# EasyEDA Pro project kuafu01_030内部老化方案_4.eprj, board PCB4 (continued)
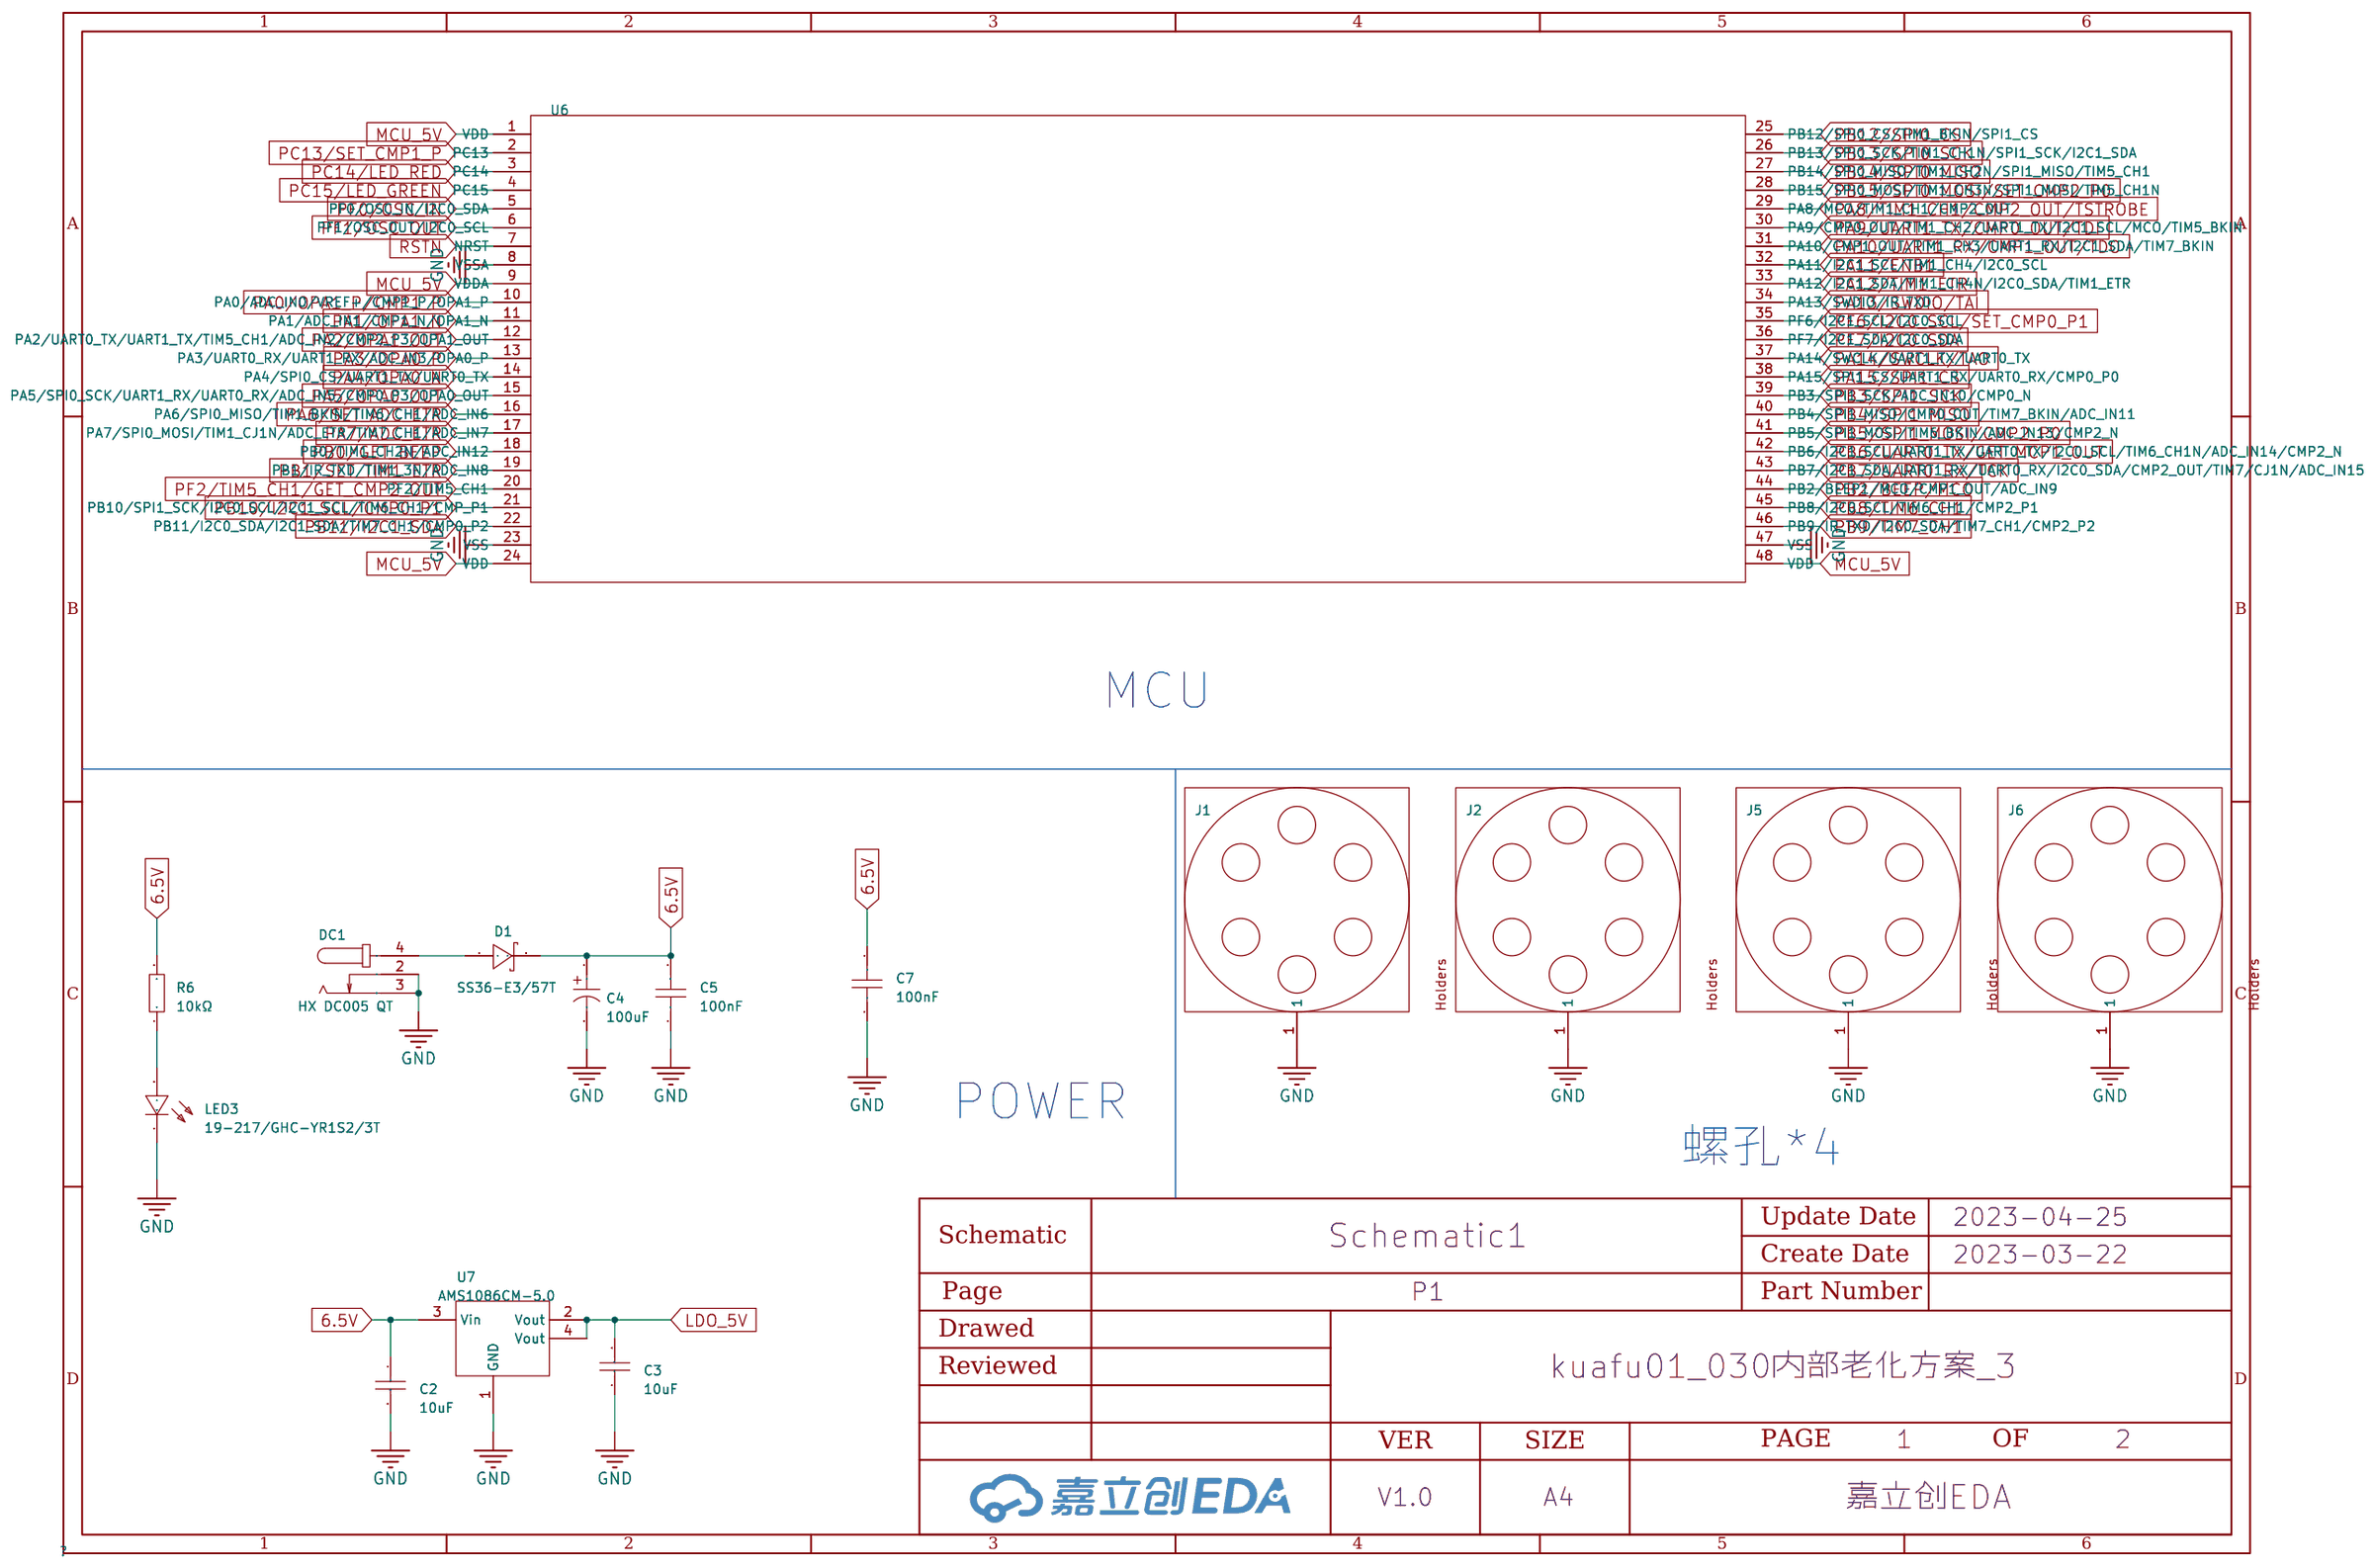
[diagram p0: P1]
## Routing (per net, layer and track width the routed paths; a pad name or vN(x,y) marks a point on that pad's centre or on a via; arc(x,y) is an arc through that point) (continued)
  Top Layer w0.5: v2(131.66,105.31) 131.66,106.78 CN2#19.3 138.35,102.93 138.35,100.24 137.42,99.31 CN1#18.9 ; v2(72.36,79.23) 73.72,79.23 U2#15.2 ; v2(173.45,116.82) 174.81,116.82 U2#9.2 ; v2(210.06,78.04) 210.06,80.2 C1#17.2 209.67,80.73 U1#19.3 209.67,84.87 C6#15.1 210.11,85.97 v2(209.45,86.63) ; v2(232.75,142.9) 232.75,144.38 CN2#2.3 239.44,140.53 239.44,137.83 238.52,136.91 CN1.9 ; v2(7.87,2.85) 7.87,5.01 C1#24.2 7.48,5.54 U1#24.3 7.48,9.68 C6#24.1 7.92,10.78 v2(7.26,11.44) ; v2(19.5,160.56) 19.47,160.53 19.47,159.34 20.12,158.69 v2(21.81,158.69) ; v2(57.81,124.22) 58.47,123.56 C6#7.1 58.03,122.46 U1#9.3 58.03,118.32 C1#7.2 58.42,117.79 v2(58.42,115.63) ; v2(224,8.32) 222.31,8.32 221.66,8.97 221.66,10.16 v2(221.69,10.19) ; v2(72.36,116.82) 73.72,116.82 U2#3.2 ; CN1#7.9 137.42,174.5 138.35,175.42 138.35,178.12 CN2#8.3 131.66,181.97 v2(131.66,180.49) ; v2(182.2,67.71) 182.2,69.19 CN2#21.3 188.89,65.34 188.89,62.64 187.97,61.72 CN1#21.9 ; v2(131.66,218.08) 131.66,219.56 CN2#31.3 138.35,215.71 138.35,213.01 137.42,212.09 CN1#31.9 ; v2(7.87,153.22) 7.87,155.38 C1#4.2 7.48,155.91 U1#6.3 7.48,160.05 C6#5.1 7.92,161.15 v2(7.26,161.81) ; v2(58.42,78.04) 58.42,80.2 C1#19.2 58.03,80.73 U1#21.3 58.03,84.87 C6#19.1 58.47,85.97 v2(57.81,86.63) ; v2(72.36,154.41) 73.72,154.41 U2#4.2 ; v2(232.75,255.67) 232.75,257.15 CN2#26.3 239.44,253.3 239.44,250.6 238.52,249.68 CN1#26.9 ; U2#23.2 23.17,229.59 v2(21.81,229.59) ; v2(7.87,78.04) 7.87,80.2 C1#15.2 7.48,80.73 U1#17.3 7.48,84.87 C6#16.1 7.92,85.97 v2(7.26,86.63) ; v2(158.9,86.63) 159.56,85.97 C6#21.1 159.12,84.87 U1#23.3 159.12,80.73 C1#21.2 159.51,80.2 v2(159.51,78.04) ; v2(72.36,121.1) 70.67,121.1 70.02,121.75 70.02,122.94 v2(70.05,122.97) ; v2(158.9,161.81) 159.56,161.15 C6#10.1 159.12,160.05 U1#11.3 159.12,155.91 C1#10.2 159.51,155.38 v2(159.51,153.22) ; v2(224,41.63) 225.36,41.63 U2#18.2 ; CN1#23.9 238.52,24.13 239.44,25.05 239.44,27.75 CN2#24.3 232.75,31.6 v2(232.75,30.12) ; U2#25.2 225.36,4.04 v2(224,4.04) ; v2(70.05,198.15) 70.02,198.12 70.02,196.93 70.67,196.28 v2(72.36,196.28) ; v2(158.9,199.4) 159.56,198.74 C6#32.1 159.12,197.64 U1#30.3 159.12,193.5 C1#29.2 159.51,192.97 v2(159.51,190.81) ; v2(21.81,41.63) 23.17,41.63 U2#13.2 ; v2(173.45,41.63) 174.81,41.63 U2#19.2 ; v2(21.81,192) 23.17,192 U2#30.2 ; CN1#24.9 36.33,249.68 37.25,250.6 37.25,253.3 CN2#25.3 30.56,257.15 v2(30.56,255.67) ; v2(30.56,67.71) 30.56,69.19 CN2#12.3 37.25,65.34 37.25,62.64 36.33,61.72 CN1#15.9 ; CN1#27.9 36.33,212.09 37.25,213.01 37.25,215.71 CN2#28.3 30.56,219.56 v2(30.56,218.08) ; CN1#13.9 187.97,99.31 188.89,100.24 188.89,102.93 CN2#15.3 182.2,106.78 v2(182.2,105.31) ; v2(210.06,2.85) 210.06,5.01 C1#25.2 209.67,5.54 U1#25.3 209.67,9.68 C6#25.1 210.11,10.78 v2(209.45,11.44) ; v2(221.69,160.56) 221.66,160.53 221.66,159.34 222.31,158.69 v2(224,158.69) ; CN1#22.9 36.33,24.13 37.25,25.05 37.25,27.75 CN2#23.3 30.56,31.6 v2(30.56,30.12) ; U2#6.2 23.17,154.41 v2(21.81,154.41) ; v2(21.81,196.28) 20.12,196.28 19.47,196.93 19.47,198.12 v2(19.5,198.15) ; v2(122.91,229.59) 124.27,229.59 U2#21.2 ; v2(173.45,196.28) 171.76,196.28 171.11,196.93 171.11,198.12 v2(171.14,198.15) ; v2(108.97,153.22) 108.97,155.38 C1#11.2 108.58,155.91 U1#3.3 108.58,160.05 C6#11.1 109.01,161.15 v2(108.36,161.81) ; v2(21.81,233.87) 20.12,233.87 19.47,234.52 19.47,235.71 v2(19.5,235.74) ; v2(72.36,83.51) 70.67,83.51 70.02,84.16 70.02,85.35 v2(70.05,85.38) ; U2#8.2 73.72,229.59 v2(72.36,229.59) ; v2(81.11,218.08) 81.11,219.56 CN2#32.3 87.8,215.71 87.8,213.01 86.88,212.09 CN1#30.9 ; v2(7.87,228.4) 7.87,230.56 C1#22.2 7.48,231.09 U1#22.3 7.48,235.24 C6#23.1 7.92,236.34 v2(7.26,236.99) ; 99.41,3.36 99.42,3.37 C7.1 ; 99.41,3.36 97.02,3.36 ; 99.41,3.36 123.54,3.36 ; 97.02,3.36 97.04,3.38 C5.1 ; 97.02,3.36 94.64,3.36 ; v2(21.81,79.23) 23.17,79.23 U2#17.2 ; v2(224,154.41) 225.36,154.41 U2#5.2 ; CN1#29.9 238.52,212.09 239.44,213.01 239.44,215.71 CN2#30.3 232.75,219.56 v2(232.75,218.08) ; v2(21.81,4.04) 23.17,4.04 U2#24.2 ; v2(70.05,160.56) 70.02,160.53 70.02,159.34 70.67,158.69 v2(72.36,158.69) ; U2#10.2 174.81,154.41 v2(173.45,154.41) ; v2(159.51,40.44) 159.51,42.6 C1#12.2 159.12,43.13 U1#13.3 159.12,47.28 C6#20.1 159.56,48.38 v2(158.9,49.03) ; U2#22.2 124.27,79.23 v2(122.91,79.23) ; v2(19.5,122.97) 19.47,122.94 19.47,121.75 20.12,121.1 v2(21.81,121.1) ; v2(21.81,45.91) 20.12,45.91 19.47,46.56 19.47,47.75 v2(19.5,47.78) ; v2(224,192) 225.36,192 U2#28.2 ; v2(120.6,47.78) 120.57,47.75 120.57,46.56 121.22,45.91 v2(122.91,45.91) ; v2(173.45,233.87) 171.76,233.87 171.11,234.52 171.11,235.71 v2(171.14,235.74) ; v2(224,121.1) 222.31,121.1 221.66,121.75 221.66,122.94 v2(221.69,122.97) ; v2(221.69,47.78) 221.66,47.75 221.66,46.56 222.31,45.91 v2(224,45.91) ; v2(81.11,67.71) 81.11,69.19 CN2#16.3 87.8,65.34 87.8,62.64 86.88,61.72 CN1#16.9 ; CN1#4.9 36.33,136.91 37.25,137.83 37.25,140.53 CN2.3 30.56,144.38 v2(30.56,142.9) ; v2(209.45,199.4) 210.11,198.74 C6#29.1 209.67,197.64 U1#31.3 209.67,193.5 C1#30.2 210.06,192.97 v2(210.06,190.81) ; v2(210.06,153.22) 210.06,155.38 C1#6.2 209.67,155.91 U1#8.3 209.67,160.05 C6#4.1 210.11,161.15 v2(209.45,161.81) ; v2(108.97,78.04) 108.97,80.2 C1#23.2 108.58,80.73 U1#14.3 108.58,84.87 C6#22.1 109.01,85.97 v2(108.36,86.63) ; v2(210.06,228.4) 210.06,230.56 C1#27.2 209.67,231.09 U1#27.3 209.67,235.24 C6#27.1 210.11,236.34 v2(209.45,236.99) ; v2(221.69,198.15) 221.66,198.12 221.66,196.93 222.31,196.28 v2(224,196.28) ; v2(57.81,199.4) 58.47,198.74 C6#31.1 58.03,197.64 U1#32.3 58.03,193.5 C1#32.2 58.42,192.97 v2(58.42,190.81) ; v2(122.91,41.63) 124.27,41.63 U2#12.2 ; v2(72.36,41.63) 73.72,41.63 U2#14.2 ; v2(224,229.59) 225.36,229.59 U2#27.2 ; v2(21.81,8.32) 20.12,8.32 19.47,8.97 19.47,10.16 v2(19.5,10.19) ; CN1#19.9 137.42,61.72 138.35,62.64 138.35,65.34 CN2#14.3 131.66,69.19 v2(131.66,67.71) ; v2(70.05,235.74) 70.02,235.71 70.02,234.52 70.67,233.87 v2(72.36,233.87) ; CN1#8.9 137.42,136.91 138.35,137.83 138.35,140.53 CN2#3.3 131.66,144.38 v2(131.66,142.9) ; CN1#12.9 238.52,61.72 239.44,62.64 239.44,65.34 CN2#13.3 232.75,69.19 v2(232.75,67.71) ; v2(58.42,40.44) 58.42,42.6 C1#18.2 58.03,43.13 U1#20.3 58.03,47.28 C6#18.1 58.47,48.38 v2(57.81,49.03) ; v2(171.14,47.78) 171.11,47.75 171.11,46.56 171.76,45.91 v2(173.45,45.91) ; v2(30.56,180.49) 30.56,181.97 CN2#6.3 37.25,178.12 37.25,175.42 36.33,174.5 CN1#3.9 ; CN1#20.9 86.88,99.31 87.8,100.24 87.8,102.93 CN2#20.3 81.11,106.78 v2(81.11,105.31) ; v2(81.11,142.9) 81.11,144.38 CN2#5.3 87.8,140.53 87.8,137.83 86.88,136.91 CN1#5.9 ; v2(122.91,83.51) 121.22,83.51 120.57,84.16 120.57,85.35 v2(120.6,85.38) ; CN1#6.9 238.52,174.5 239.44,175.42 239.44,178.12 CN2#7.3 232.75,181.97 v2(232.75,180.49) ; 123.54,3.36 142.33,3.36 153.07,14.1 ; 123.54,3.36 123.48,3.43 C3.1 ; v2(108.36,124.22) 109.01,123.56 C6.1 108.58,122.46 U1#5.3 108.58,118.32 C1#3.2 108.97,117.79 v2(108.97,115.63) ; v2(19.5,85.38) 19.47,85.35 19.47,84.16 20.12,83.51 v2(21.81,83.51) ; v2(30.56,105.31) 30.56,106.78 CN2#17.3 37.25,102.93 37.25,100.24 36.33,99.31 CN1#14.9 ; v2(7.87,40.44) 7.87,42.6 C1#16.2 7.48,43.13 U1#15.3 7.48,47.28 C6#13.1 7.92,48.38 v2(7.26,49.03) ; v2(7.26,124.22) 7.92,123.56 C6#3.1 7.48,122.46 U1#4.3 7.48,118.32 C1#5.2 7.87,117.79 v2(7.87,115.63) ; v2(72.36,45.91) 70.67,45.91 70.02,46.56 70.02,47.75 v2(70.05,47.78) ; v2(122.91,121.1) 121.22,121.1 120.57,121.75 120.57,122.94 v2(120.6,122.97) ; U2#11.2 124.27,154.41 v2(122.91,154.41) ; CN1#25.9 187.97,249.68 188.89,250.6 188.89,253.3 CN2#22.3 182.2,257.15 v2(182.2,255.67) ; C2.2 91.55,3.38 91.53,3.36 ; v2(182.2,142.9) 182.2,144.38 CN2#10.3 188.89,140.53 188.89,137.83 187.97,136.91 CN1#10.9 ; U2#32.2 174.81,192 v2(173.45,192) ; U2#7.2 225.36,116.82 v2(224,116.82) ; v2(232.75,105.31) 232.75,106.78 CN2#18.3 239.44,102.93 239.44,100.24 238.52,99.31 CN1#17.9 ; v2(173.45,79.23) 174.81,79.23 U2#20.2 ; v2(224,79.23) 225.36,79.23 U2#16.2 ; v2(158.9,124.22) 159.56,123.56 C6#9.1 159.12,122.46 U1#2.3 159.12,118.32 C1.2 159.51,117.79 v2(159.51,115.63) ; U2#29.2 73.72,192 v2(72.36,192) ; v2(57.81,236.99) 58.47,236.34 C6#2.1 58.03,235.24 U1.3 58.03,231.09 C1#2.2 58.42,230.56 v2(58.42,228.4) ; v2(182.2,218.08) 182.2,219.56 CN2#29.3 188.89,215.71 188.89,213.01 187.97,212.09 CN1#28.9 ; v2(122.91,196.28) 121.22,196.28 120.57,196.93 120.57,198.12 v2(120.6,198.15) ; v2(122.91,158.69) 121.22,158.69 120.57,159.34 120.57,160.53 v2(120.6,160.56) ; 94.64,3.36 91.53,3.36 ; 94.64,3.36 94.67,3.39 LED3.1 ; 91.53,3.36 C4.2 86.55,3.36 DC1.2 73.72,9.59 72.42,9.59 72.23,9.4 67.56,9.4 63.5,13.46 63.5,16.51 67.1,20.11 U7.1 v2(103.51,27.43) ; v2(7.26,199.4) 7.92,198.74 C6#30.1 7.48,197.64 U1#29.3 7.48,193.5 C1#31.2 7.87,192.97 v2(7.87,190.81) ; v2(81.11,180.49) 81.11,181.97 CN2#9.3 87.8,178.12 87.8,175.42 86.88,174.5 CN1#9.9 ; v2(122.91,116.82) 124.27,116.82 U2.2 ; v2(158.9,236.99) 159.56,236.34 C6#26.1 159.12,235.24 U1#26.3 159.12,231.09 C1#26.2 159.51,230.56 v2(159.51,228.4) ; v2(171.14,160.56) 171.11,160.53 171.11,159.34 171.76,158.69 v2(173.45,158.69) ; v2(120.6,235.74) 120.57,235.71 120.57,234.52 121.22,233.87 v2(122.91,233.87) ; v2(122.91,192) 124.27,192 U2#31.2 ; v2(108.97,228.4) 108.97,230.56 C1#13.2 108.58,231.09 U1#12.3 108.58,235.24 C6#14.1 109.01,236.34 v2(108.36,236.99) ; v2(210.06,115.63) 210.06,117.79 C1#9.2 209.67,118.32 U1#7.3 209.67,122.46 C6#6.1 210.11,123.56 v2(209.45,124.22) ; v2(182.2,180.49) 182.2,181.97 CN2#4.3 188.89,178.12 188.89,175.42 187.97,174.5 CN1#2.9 ; v2(21.81,116.82) 23.17,116.82 U2#2.2 ; v2(210.06,40.44) 210.06,42.6 C1#20.2 209.67,43.13 U1#18.3 209.67,47.28 C6#17.1 210.11,48.38 v2(209.45,49.03) ; v2(224,233.87) 222.31,233.87 221.66,234.52 221.66,235.71 v2(221.69,235.74) ; v2(171.14,122.97) 171.11,122.94 171.11,121.75 171.76,121.1 v2(173.45,121.1) ; CN1#32.9 86.88,249.68 87.8,250.6 87.8,253.3 CN2#27.3 81.11,257.15 v2(81.11,255.67) ; v2(108.36,199.4) 109.01,198.74 C6#28.1 108.58,197.64 U1#28.3 108.58,193.5 C1#28.2 108.97,192.97 v2(108.97,190.81) ; v2(173.45,229.59) 174.81,229.59 U2#26.2 ; v2(221.69,85.38) 221.66,85.35 221.66,84.16 222.31,83.51 v2(224,83.51) ; v2(173.45,83.51) 171.76,83.51 171.11,84.16 171.11,85.35 v2(171.14,85.38) ; U7#2.1 v2(131.57,27.43) ; v2(131.66,255.67) 131.66,257.15 CN2#11.3 138.35,253.3 138.35,250.6 137.42,249.68 CN1#11.9 ; v2(108.97,40.44) 108.97,42.6 C1#14.2 108.58,43.13 U1#16.3 108.58,47.28 C6#12.1 109.01,48.38 v2(108.36,49.03) ; v2(57.81,161.81) 58.47,161.15 C6#8.1 58.03,160.05 U1#10.3 58.03,155.91 C1#8.2 58.42,155.38 v2(58.42,153.22)
  Bottom Layer w0.28: v2(76.16,142.81) 76.25,142.9 v2(81.11,142.9) ; v2(126.71,180.4) 126.8,180.49 v2(131.66,180.49) ; v2(25.61,142.81) 25.7,142.9 v2(30.56,142.9) ; v2(30.56,67.71) 25.7,67.71 v2(25.61,67.62) ; v2(131.66,105.31) 126.8,105.31 v2(126.71,105.22) ; v2(232.75,142.9) 227.89,142.9 v2(227.8,142.81) ; v2(76.16,217.99) 76.25,218.08 v2(81.11,218.08) ; v2(177.25,67.62) 177.34,67.71 v2(182.2,67.71) ; v2(25.61,30.03) 25.7,30.12 v2(30.56,30.12) ; v2(30.56,105.31) 25.7,105.31 v2(25.61,105.22) ; v2(232.75,180.49) 227.89,180.49 v2(227.8,180.4) ; v2(131.66,255.67) 126.8,255.67 v2(126.71,255.58) ; v2(30.56,218.08) 25.7,218.08 v2(25.61,217.99) ; v2(81.11,67.71) 76.25,67.71 v2(76.16,67.62) ; v2(227.8,30.03) 227.89,30.12 v2(232.75,30.12) ; v2(177.25,105.22) 177.34,105.31 v2(182.2,105.31) ; v2(227.8,217.99) 227.89,218.08 v2(232.75,218.08) ; v2(177.25,180.4) 177.34,180.49 v2(182.2,180.49) ; v2(25.61,180.4) 25.7,180.49 v2(30.56,180.49) ; v2(131.66,67.71) 126.8,67.71 v2(126.71,67.62) ; v2(131.66,218.08) 126.8,218.08 v2(126.71,217.99) ; v2(227.8,67.62) 227.89,67.71 v2(232.75,67.71) ; v2(182.2,142.9) 177.34,142.9 v2(177.25,142.81) ; v2(76.16,180.4) 76.25,180.49 v2(81.11,180.49) ; v2(177.25,217.99) 177.34,218.08 v2(182.2,218.08) ; v2(30.56,255.67) 25.7,255.67 v2(25.61,255.58) ; v2(227.8,255.58) 227.89,255.67 v2(232.75,255.67) ; v2(131.66,142.9) 126.8,142.9 v2(126.71,142.81) ; v2(76.16,105.22) 76.25,105.31 v2(81.11,105.31) ; v2(177.25,255.58) 177.34,255.67 v2(182.2,255.67) ; v2(81.11,255.67) 76.25,255.67 v2(76.16,255.58) ; v2(227.8,105.22) 227.89,105.31 v2(232.75,105.31)
  Bottom Layer w0.5: v2(224,83.51) 224,80.88 ; 224,80.88 v2(224,79.23) 221.89,77.12 210.98,77.12 v2(210.06,78.04) ; 224,80.88 237.67,80.88 238.21,81.41 238.21,82.28 237.97,82.52 v2(236.62,82.52) ; v2(121.53,202.98) 121.53,217.99 ; 183.62,111.51 234.17,111.51 ; 183.62,111.51 CN2#15.3 ; 183.62,111.51 134.37,111.51 133.08,110.22 CN2#19.3 ; 234.17,111.51 CN2#18.3 ; 234.17,111.51 258.57,111.51 ; v2(57.81,199.4) 56.3,199.4 55.61,200.09 55.61,209.54 64.06,217.99 v2(76.16,217.99) ; v2(186.07,120.11) 187.42,120.11 187.66,119.87 187.66,119.01 187.13,118.47 173.45,118.47 ; v2(70.98,202.98) 70.98,217.99 ; v2(227.8,105.22) 215.7,105.22 207.25,96.77 207.25,87.32 207.94,86.63 v2(209.45,86.63) ; 224,5.7 237.67,5.7 238.21,6.23 238.21,7.09 237.97,7.33 v2(236.62,7.33) ; 224,5.7 v2(224,4.04) 221.89,1.93 210.98,1.93 v2(210.06,2.85) ; 224,5.7 v2(224,8.32) ; 224,193.66 237.67,193.66 238.21,194.19 238.21,195.05 237.97,195.29 v2(236.62,195.29) ; 224,193.66 v2(224,196.28) ; 224,193.66 v2(224,192) 221.89,189.89 210.98,189.89 v2(210.06,190.81) ; v2(122.91,83.51) 122.91,80.88 ; 122.91,80.88 v2(122.91,79.23) 120.8,77.12 109.89,77.12 v2(108.97,78.04) ; 122.91,80.88 136.58,80.88 137.11,81.41 137.11,82.28 136.88,82.52 v2(135.53,82.52) ; v2(227.8,67.62) 215.7,67.62 207.25,59.17 207.25,49.72 207.94,49.03 v2(209.45,49.03) ; v2(223.71,123.44) 223.24,122.97 v2(221.69,122.97) ; v2(7.87,228.4) 8.79,227.48 19.7,227.48 v2(21.81,229.59) 21.81,231.25 ; v2(72.07,198.62) 71.6,198.15 v2(70.05,198.15) ; v2(171.14,85.38) 172.69,85.38 v2(173.16,85.85) ; 258.57,224.3 258.57,186.69 ; 258.57,224.3 258.57,259.84 256.54,261.87 234.17,261.87 ; 258.57,224.3 258.56,224.28 234.17,224.28 ; 258.57,186.69 258.57,149.08 ; 258.57,186.69 258.57,186.69 234.17,186.69 ; v2(21.52,123.44) 21.05,122.97 v2(19.5,122.97) ; v2(84.98,195.29) 86.33,195.29 86.57,195.05 86.57,194.19 86.04,193.66 72.36,193.66 ; v2(122.91,158.69) 122.91,156.07 ; 122.91,156.07 136.58,156.07 137.11,156.6 137.11,157.46 136.88,157.7 v2(135.53,157.7) ; 122.91,156.07 v2(122.91,154.41) 120.8,152.3 109.89,152.3 v2(108.97,153.22) ; 31.98,261.87 5.84,261.87 3.81,259.84 3.81,224.19 ; 31.98,261.87 CN2#25.3 ; 31.98,261.87 82.53,261.87 ; 122.91,43.29 v2(122.91,41.63) 120.8,39.52 109.89,39.52 v2(108.97,40.44) ; 122.91,43.29 136.58,43.29 137.11,43.82 137.11,44.69 136.88,44.92 v2(135.53,44.92) ; 122.91,43.29 v2(122.91,45.91) ; v2(19.5,160.56) 21.05,160.56 v2(21.52,161.03) ; 3.81,224.19 3.81,186.62 ; 3.81,224.19 3.91,224.28 31.98,224.28 ; 21.81,43.29 v2(21.81,41.63) 19.7,39.52 8.79,39.52 v2(7.87,40.44) ; 21.81,43.29 35.49,43.29 36.02,43.82 36.02,44.69 35.78,44.92 v2(34.43,44.92) ; 21.81,43.29 v2(21.81,45.91) ; v2(171.14,122.97) 172.69,122.97 v2(173.16,123.44) ; v2(25.61,180.4) 13.51,180.4 5.06,171.95 5.06,162.5 5.75,161.81 v2(7.26,161.81) ; v2(173.45,233.87) 173.45,231.25 ; 173.45,231.25 v2(173.45,229.59) 171.34,227.48 160.43,227.48 v2(159.51,228.4) ; 173.45,231.25 187.13,231.25 187.66,231.78 187.66,232.65 187.42,232.88 v2(186.07,232.88) ; v2(84.98,232.88) 86.33,232.88 86.57,232.65 86.57,231.78 86.04,231.25 72.36,231.25 ; v2(210.06,40.44) 210.98,39.52 221.89,39.52 v2(224,41.63) 224,43.29 ; v2(126.71,105.22) 114.61,105.22 106.16,96.77 106.16,87.32 106.85,86.63 v2(108.36,86.63) ; 21.81,193.66 35.49,193.66 36.02,194.19 36.02,195.05 35.78,195.29 v2(34.43,195.29) ; 21.81,193.66 v2(21.81,192) 19.7,189.89 8.79,189.89 v2(7.87,190.81) ; 21.81,193.66 v2(21.81,196.28) ; 3.81,111.52 3.81,73.94 ; 3.81,111.52 3.81,149.15 ; 3.81,111.52 3.82,111.51 31.98,111.51 ; 3.81,73.94 3.81,38.35 5.59,36.58 31.98,36.58 ; 3.81,73.94 3.84,73.91 31.98,73.91 ; v2(57.81,86.63) 56.3,86.63 55.61,87.32 55.61,96.77 64.06,105.22 v2(76.16,105.22) ; 3.81,186.62 3.81,149.15 ; 3.81,186.62 3.88,186.69 31.98,186.69 ; 3.81,149.15 3.86,149.1 31.98,149.1 ; 31.98,36.58 CN2#23.3 ; 31.98,36.58 103.54,36.58 ; v2(20.43,202.98) 20.43,217.99 ; v2(122.62,161.03) 122.15,160.56 v2(120.6,160.56) ; v2(172.07,165.39) 172.07,180.4 ; v2(186.07,157.7) 187.42,157.7 187.66,157.46 187.66,156.6 187.13,156.07 173.45,156.07 ; 21.81,5.7 35.49,5.7 36.02,6.23 36.02,7.09 35.78,7.33 v2(34.43,7.33) ; 21.81,5.7 v2(21.81,8.32) ; 21.81,5.7 v2(21.81,4.04) 19.7,1.93 8.79,1.93 v2(7.87,2.85) ; v2(21.81,158.69) 21.81,156.07 ; 21.81,156.07 v2(21.81,154.41) 19.7,152.3 8.79,152.3 v2(7.87,153.22) ; 21.81,156.07 35.49,156.07 36.02,156.6 36.02,157.46 35.78,157.7 v2(34.43,157.7) ; 122.91,118.47 136.58,118.47 137.11,119.01 137.11,119.87 136.88,120.11 v2(135.53,120.11) ; 122.91,118.47 v2(122.91,116.82) 120.8,114.71 109.89,114.71 v2(108.97,115.63) ; 122.91,118.47 v2(122.91,121.1) ; CN2#6.3 31.98,186.69 ; 31.98,186.69 82.53,186.69 ; 258.57,149.08 258.56,149.1 234.17,149.1 ; 258.57,149.08 258.57,38.1 257.05,36.58 234.21,36.58 ; v2(70.98,165.39) 70.98,180.4 ; v2(159.51,153.22) 160.43,152.3 171.34,152.3 v2(173.45,154.41) 173.45,156.07 ; v2(171.14,47.78) 172.69,47.78 v2(173.16,48.25) ; 103.54,36.58 103.51,36.54 v2(103.51,27.43) ; 103.54,36.58 131.57,36.58 ; v2(222.62,240.57) 222.62,255.58 ; 72.36,193.66 v2(72.36,196.28) ; 72.36,193.66 v2(72.36,192) 70.25,189.89 59.34,189.89 v2(58.42,190.81) ; v2(58.42,78.04) 59.34,77.12 70.25,77.12 v2(72.36,79.23) 72.36,80.88 ; 173.45,43.29 v2(173.45,41.63) 171.34,39.52 160.43,39.52 v2(159.51,40.44) ; 173.45,43.29 187.13,43.29 187.66,43.82 187.66,44.69 187.42,44.92 v2(186.07,44.92) ; 173.45,43.29 v2(173.45,45.91) ; 82.53,186.69 131.57,186.69 133.08,185.19 CN2#8.3 ; 82.53,186.69 CN2#9.3 ; v2(236.62,157.7) 237.97,157.7 238.21,157.46 238.21,156.6 237.67,156.07 224,156.07 ; v2(121.53,90.21) 121.53,105.21 ; v2(25.61,217.99) 13.51,217.99 5.06,209.54 5.06,200.09 5.75,199.4 v2(7.26,199.4) ; v2(70.98,52.61) 70.98,67.62 ; v2(7.26,236.99) 5.75,236.99 5.06,237.68 5.06,247.13 13.51,255.58 v2(25.61,255.58) ; v2(222.62,90.21) 222.62,105.21 ; 72.36,118.47 v2(72.36,116.82) 70.25,114.71 59.34,114.71 v2(58.42,115.63) ; 72.36,118.47 v2(72.36,121.1) ; 72.36,118.47 86.04,118.47 86.57,119.01 86.57,119.87 86.33,120.11 v2(84.98,120.11) ; v2(120.6,85.38) 122.15,85.38 v2(122.62,85.85) ; v2(7.26,86.63) 5.75,86.63 5.06,87.32 5.06,96.77 13.51,105.22 v2(25.61,105.22) ; 72.36,43.29 86.04,43.29 86.57,43.82 86.57,44.69 86.33,44.92 v2(84.98,44.92) ; 72.36,43.29 v2(72.36,41.63) 70.25,39.52 59.34,39.52 v2(58.42,40.44) ; 72.36,43.29 v2(72.36,45.91) ; v2(76.16,67.62) 64.06,67.62 55.61,59.17 55.61,49.72 56.3,49.03 v2(57.81,49.03) ; CN2#24.3 234.17,36.53 234.21,36.58 ; 21.81,231.25 35.49,231.25 36.02,231.78 36.02,232.65 35.78,232.88 v2(34.43,232.88) ; 21.81,231.25 v2(21.81,233.87) ; v2(19.5,85.38) 21.05,85.38 v2(21.52,85.85) ; v2(224,158.69) 224,156.07 ; 224,156.07 v2(224,154.41) 221.89,152.3 210.98,152.3 v2(210.06,153.22) ; v2(70.05,235.74) 71.6,235.74 v2(72.07,236.21) ; v2(221.69,235.74) 223.24,235.74 v2(223.71,236.21) ; v2(108.97,228.4) 109.89,227.48 120.8,227.48 v2(122.91,229.59) 122.91,231.25 ; 82.53,261.87 131.83,261.87 133.08,260.62 CN2#11.3 ; 82.53,261.87 CN2#27.3 ; v2(224,45.91) 224,43.29 ; 224,43.29 237.67,43.29 238.21,43.82 238.21,44.69 237.97,44.92 v2(236.62,44.92) ; 173.45,156.07 v2(173.45,158.69) ; v2(159.51,78.04) 160.43,77.12 171.34,77.12 v2(173.45,79.23) 173.45,80.88 ; v2(158.9,199.4) 157.39,199.4 156.7,200.09 156.7,209.54 165.15,217.99 v2(177.25,217.99) ; CN2#30.3 234.17,224.28 ; 234.17,224.28 184.38,224.28 183.62,223.52 CN2#29.3 ; v2(223.71,85.85) 223.24,85.38 v2(221.69,85.38) ; 31.98,149.1 CN2.3 ; 31.98,149.1 81.28,149.1 82.53,147.85 CN2#5.3 ; CN2#28.3 31.98,224.28 ; 31.98,224.28 82.53,224.28 ; v2(72.36,233.87) 72.36,231.25 ; 72.36,231.25 v2(72.36,229.59) 70.25,227.48 59.34,227.48 v2(58.42,228.4) ; CN2#12.3 31.98,73.91 ; 31.98,73.91 81.28,73.91 82.53,72.66 CN2#16.3 ; 224,118.47 v2(224,116.82) 221.89,114.71 210.98,114.71 v2(210.06,115.63) ; 224,118.47 v2(224,121.1) ; 224,118.47 237.67,118.47 238.21,119.01 238.21,119.87 237.97,120.11 v2(236.62,120.11) ; CN2#4.3 183.62,185.65 184.66,186.69 234.17,186.69 ; v2(120.6,235.74) 122.15,235.74 v2(122.62,236.21) ; v2(210.06,228.4) 210.98,227.48 221.89,227.48 v2(224,229.59) 224,231.25 ; v2(121.53,127.8) 121.53,142.81 ; v2(108.36,161.81) 106.85,161.81 106.16,162.5 106.16,171.95 114.61,180.4 v2(126.71,180.4) ; v2(122.91,233.87) 122.91,231.25 ; 122.91,231.25 136.58,231.25 137.11,231.78 137.11,232.65 136.88,232.88 v2(135.53,232.88) ; v2(209.45,11.44) 207.94,11.44 207.25,12.13 207.25,21.58 215.7,30.03 v2(227.8,30.03) ; 234.17,149.1 CN2#2.3 ; 234.17,149.1 183.62,149.1 ; v2(131.57,27.43) 131.57,36.57 131.57,36.58 ; v2(108.36,236.99) 106.85,236.99 106.16,237.68 106.16,247.13 114.61,255.58 v2(126.71,255.58) ; v2(20.43,90.21) 20.43,105.21 ; CN2#14.3 133.08,72.37 134.62,73.91 183.62,73.91 ; CN2#26.3 234.17,261.87 ; 234.17,261.87 184.66,261.87 183.62,260.84 CN2#22.3 ; CN2#13.3 234.17,73.91 ; 234.17,73.91 183.62,73.91 ; 234.17,73.91 258.57,73.91 ; 122.91,193.66 v2(122.91,192) 120.8,189.89 109.89,189.89 v2(108.97,190.81) ; 122.91,193.66 136.58,193.66 137.11,194.19 137.11,195.05 136.88,195.29 v2(135.53,195.29) ; 122.91,193.66 v2(122.91,196.28) ; v2(223.71,48.25) 223.24,47.78 v2(221.69,47.78) ; v2(84.98,157.7) 86.33,157.7 86.57,157.46 86.57,156.6 86.04,156.07 72.36,156.07 ; v2(224,233.87) 224,231.25 ; 224,231.25 237.67,231.25 238.21,231.78 238.21,232.65 237.97,232.88 v2(236.62,232.88) ; v2(177.25,105.22) 165.15,105.22 156.7,96.77 156.7,87.32 157.39,86.63 v2(158.9,86.63) ; v2(222.62,165.39) 222.62,180.4 ; v2(7.26,11.44) 5.75,11.44 5.06,12.13 5.06,21.58 13.51,30.03 v2(25.61,30.03) ; 72.36,80.88 v2(72.36,83.51) ; 72.36,80.88 86.04,80.88 86.57,81.41 86.57,82.28 86.33,82.52 v2(84.98,82.52) ; v2(221.69,198.15) 223.24,198.15 v2(223.71,198.62) ; v2(172.07,240.57) 172.07,255.58 ; v2(70.05,85.38) 71.6,85.38 v2(72.07,85.85) ; v2(20.43,127.8) 20.43,142.81 ; v2(57.81,236.99) 56.3,236.99 55.61,237.68 55.61,247.13 64.06,255.58 v2(76.16,255.58) ; v2(70.98,240.57) 70.98,255.58 ; v2(76.16,142.81) 64.06,142.81 55.61,134.36 55.61,124.91 56.3,124.22 v2(57.81,124.22) ; 82.53,224.28 131.57,224.28 133.08,222.78 CN2#31.3 ; 82.53,224.28 CN2#32.3 ; 21.81,118.47 v2(21.81,116.82) 19.7,114.71 8.79,114.71 v2(7.87,115.63) ; 21.81,118.47 35.49,118.47 36.02,119.01 36.02,119.87 35.78,120.11 v2(34.43,120.11) ; 21.81,118.47 v2(21.81,121.1) ; v2(173.45,196.28) 173.45,193.66 ; 173.45,193.66 v2(173.45,192) 171.34,189.89 160.43,189.89 v2(159.51,190.81) ; 173.45,193.66 187.13,193.66 187.66,194.19 187.66,195.05 187.42,195.29 v2(186.07,195.29) ; v2(21.52,236.21) 21.05,235.74 v2(19.5,235.74) ; v2(177.25,142.81) 165.15,142.81 156.7,134.36 156.7,124.91 157.39,124.22 v2(158.9,124.22) ; CN2#20.3 82.53,110 81.03,111.51 31.98,111.51 ; v2(173.16,236.21) 172.69,235.74 v2(171.14,235.74) ; v2(72.36,158.69) 72.36,156.07 ; 72.36,156.07 v2(72.36,154.41) 70.25,152.3 59.34,152.3 v2(58.42,153.22) ; v2(172.07,202.98) 172.07,217.99 ; v2(221.69,160.56) 223.24,160.56 v2(223.71,161.03) ; v2(172.07,90.21) 172.07,105.21 ; v2(223.71,10.66) 223.24,10.19 v2(221.69,10.19) ; v2(21.52,48.25) 21.05,47.78 v2(19.5,47.78) ; v2(171.14,160.56) 172.69,160.56 v2(173.16,161.03) ; v2(122.62,198.62) 122.15,198.15 v2(120.6,198.15) ; v2(172.07,127.8) 172.07,142.81 ; v2(72.07,161.03) 71.6,160.56 v2(70.05,160.56) ; v2(158.9,49.03) 157.39,49.03 156.7,49.72 156.7,59.17 165.15,67.62 v2(177.25,67.62) ; v2(227.8,180.4) 215.7,180.4 207.25,171.95 207.25,162.5 207.94,161.81 v2(209.45,161.81) ; v2(20.43,15.02) 20.43,30.03 ; CN2#17.3 31.98,111.51 ; v2(25.61,67.62) 13.51,67.62 5.06,59.17 5.06,49.72 5.75,49.03 v2(7.26,49.03) ; v2(121.53,240.57) 121.53,255.58 ; v2(108.36,199.4) 106.85,199.4 106.16,200.09 106.16,209.54 114.61,217.99 v2(126.71,217.99) ; v2(173.45,83.51) 173.45,80.88 ; 173.45,80.88 187.13,80.88 187.66,81.41 187.66,82.28 187.42,82.52 v2(186.07,82.52) ; 234.21,36.58 131.57,36.58 ; v2(159.51,115.63) 160.43,114.71 171.34,114.71 v2(173.45,116.82) 173.45,118.47 ; v2(21.52,198.62) 21.05,198.15 v2(19.5,198.15) ; v2(209.45,236.99) 207.94,236.99 207.25,237.68 207.25,247.13 215.7,255.58 v2(227.8,255.58) ; CN2#21.3 183.62,73.91 ; v2(177.25,255.58) 165.15,255.58 156.7,247.13 156.7,237.68 157.39,236.99 v2(158.9,236.99) ; v2(209.45,199.4) 207.94,199.4 207.25,200.09 207.25,209.54 215.7,217.99 v2(227.8,217.99) ; v2(70.98,127.8) 70.98,142.81 ; v2(209.45,124.22) 207.94,124.22 207.25,124.91 207.25,134.36 215.7,142.81 v2(227.8,142.81) ; v2(70.05,122.97) 71.6,122.97 v2(72.07,123.44) ; 21.81,80.88 35.49,80.88 36.02,81.41 36.02,82.28 35.78,82.52 v2(34.43,82.52) ; 21.81,80.88 v2(21.81,79.23) 19.7,77.12 8.79,77.12 v2(7.87,78.04) ; 21.81,80.88 v2(21.81,83.51) ; v2(122.62,123.44) 122.15,122.97 v2(120.6,122.97) ; 173.45,118.47 v2(173.45,121.1) ; v2(158.9,161.81) 157.39,161.81 156.7,162.5 156.7,171.95 165.15,180.4 v2(177.25,180.4) ; v2(121.53,52.61) 121.53,67.62 ; v2(126.71,67.62) 114.61,67.62 106.16,59.17 106.16,49.72 106.85,49.03 v2(108.36,49.03) ; v2(57.81,161.81) 56.3,161.81 55.61,162.5 55.61,171.95 64.06,180.4 v2(76.16,180.4) ; v2(172.07,52.61) 172.07,67.62 ; v2(25.61,142.81) 13.51,142.81 5.06,134.36 5.06,124.91 5.75,124.22 v2(7.26,124.22) ; v2(70.05,47.78) 71.6,47.78 v2(72.07,48.25) ; v2(20.43,165.39) 20.43,180.4 ; v2(108.36,124.22) 106.85,124.22 106.16,124.91 106.16,134.36 114.61,142.81 v2(126.71,142.81) ; v2(171.14,198.15) 172.69,198.15 v2(173.16,198.62) ; CN2#10.3 183.62,149.1 ; 183.62,149.1 133.58,149.1 133.08,148.59 CN2#3.3 ; v2(222.62,202.98) 222.62,217.99 ; v2(19.5,10.19) 21.05,10.19 v2(21.52,10.66) ; v2(20.43,52.61) 20.43,67.62 ; v2(222.62,52.61) 222.62,67.62 ; v2(70.98,90.21) 70.98,105.21 ; v2(122.62,48.25) 122.15,47.78 v2(120.6,47.78) ; v2(222.62,15.02) 222.62,30.03 ; 234.17,186.69 CN2#7.3 ; v2(222.62,127.8) 222.62,142.81 ; v2(121.53,165.39) 121.53,180.4 ; v2(20.43,240.57) 20.43,255.58